# EasyEDA Pro project kuafu01_030内部老化方案_4.eprj, board PCB4 (continued)
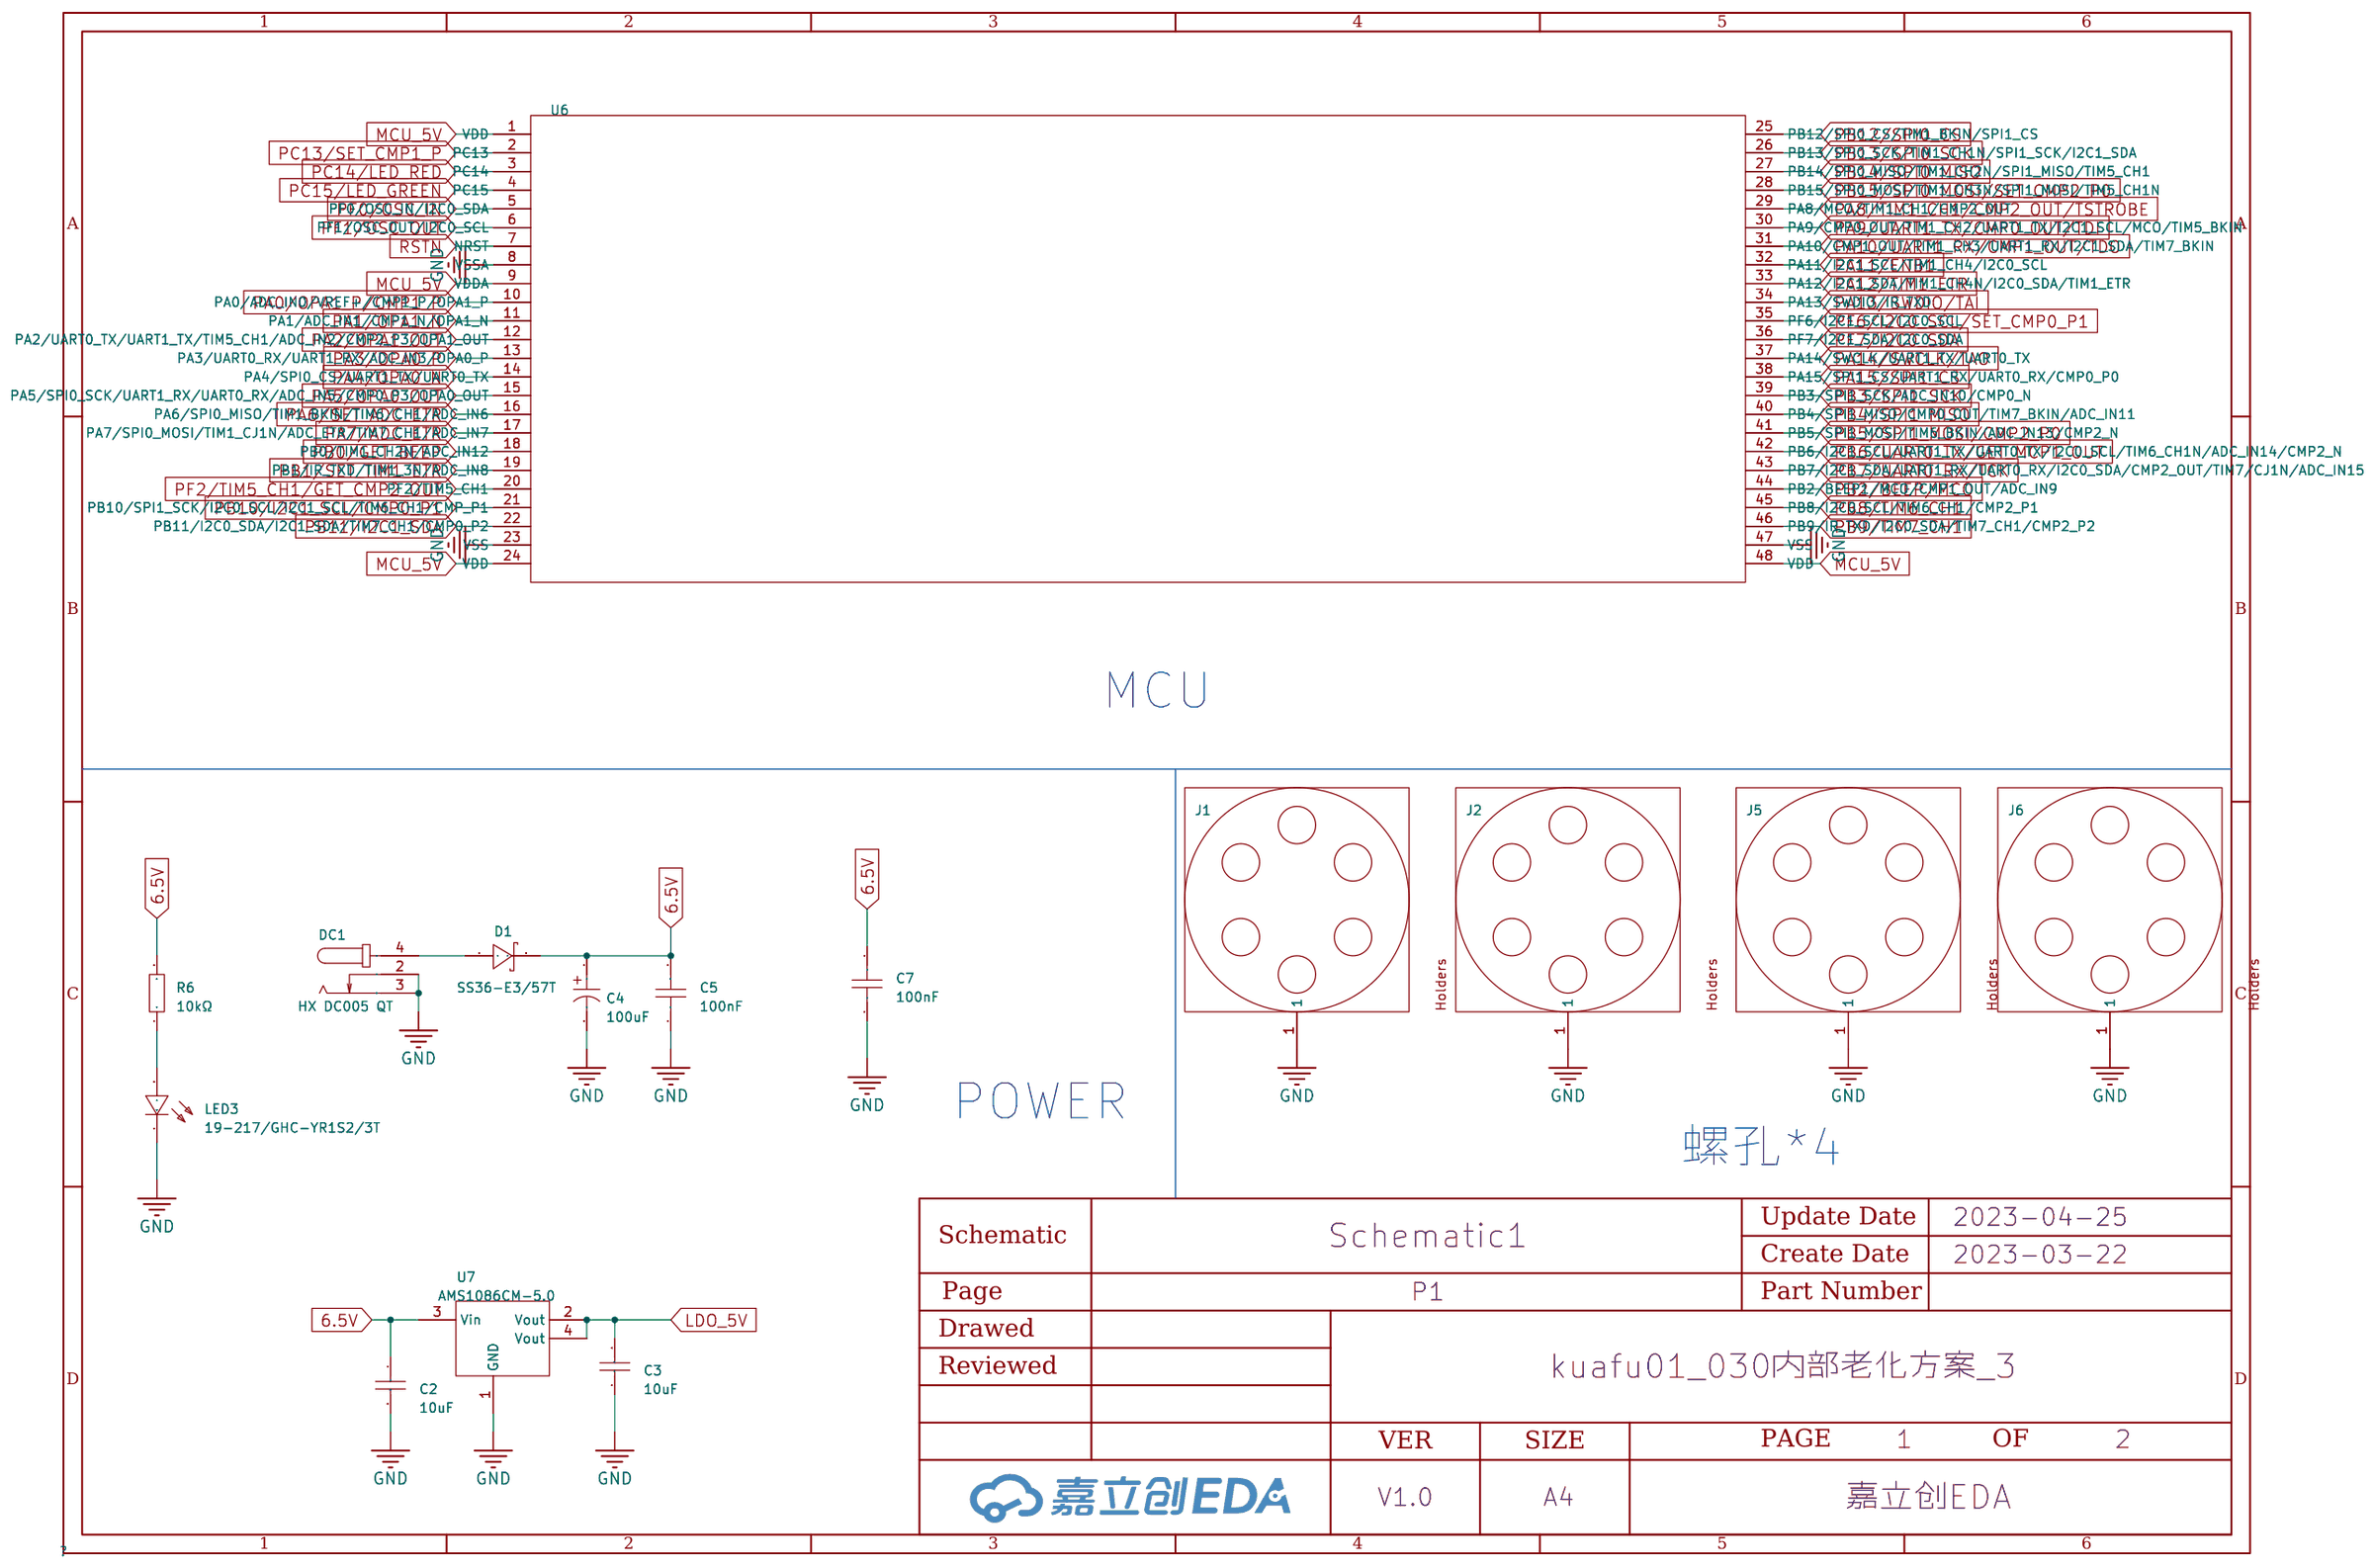
[diagram p0: P1]
## Nets (continued)
PC13/SET_CMP1_P: H7.2 H7#2.2 H7#3.2 H7#4.2 H7#5.2 H7#6.2 H7#7.2 H7#8.2 H7#9.2 H7#10.2 H7#11.2 H7#12.2 H7#13.2 H7#14.2 H7#15.2 H7#16.2 H7#17.2 H7#18.2 H7#19.2 H7#20.2 H7#21.2 H7#22.2 H7#23.2 H7#24.2 H7#25.2 H7#26.2 H7#27.2 H7#28.2 H7#29.2 H7#30.2 H7#31.2 H7#32.2 U6.2 U6#2.2 U6#3.2 U6#4.2 U6#5.2 U6#6.2 U6#7.2 U6#8.2 U6#9.2 U6#10.2 U6#11.2 U6#12.2 U6#13.2 U6#14.2 U6#15.2 U6#16.2 U6#17.2 U6#18.2 U6#19.2 U6#20.2 U6#21.2 U6#22.2 U6#23.2 U6#24.2 U6#25.2 U6#26.2 U6#27.2 U6#28.2 U6#29.2 U6#30.2 U6#31.2 U6#32.2
PC14/LED_RED: H1.2 H1#2.2 H1#3.2 H1#4.2 H1#5.2 H1#6.2 H1#7.2 H1#8.2 H1#9.2 H1#10.2 H1#11.2 H1#12.2 H1#13.2 H1#14.2 H1#15.2 H1#16.2 H1#17.2 H1#18.2 H1#19.2 H1#20.2 H1#21.2 H1#22.2 H1#23.2 H1#24.2 H1#25.2 H1#26.2 H1#27.2 H1#28.2 H1#29.2 H1#30.2 H1#31.2 H1#32.2 U6.3 U6#2.3 U6#3.3 U6#4.3 U6#5.3 U6#6.3 U6#7.3 U6#8.3 U6#9.3 U6#10.3 U6#11.3 U6#12.3 U6#13.3 U6#14.3 U6#15.3 U6#16.3 U6#17.3 U6#18.3 U6#19.3 U6#20.3 U6#21.3 U6#22.3 U6#23.3 U6#24.3 U6#25.3 U6#26.3 U6#27.3 U6#28.3 U6#29.3 U6#30.3 U6#31.3 U6#32.3
PC15/LED_GREEN: H2.2 H2#2.2 H2#3.2 H2#4.2 H2#5.2 H2#6.2 H2#7.2 H2#8.2 H2#9.2 H2#10.2 H2#11.2 H2#12.2 H2#13.2 H2#14.2 H2#15.2 H2#16.2 H2#17.2 H2#18.2 H2#19.2 H2#20.2 H2#21.2 H2#22.2 H2#23.2 H2#24.2 H2#25.2 H2#26.2 H2#27.2 H2#28.2 H2#29.2 H2#30.2 H2#31.2 H2#32.2 U6.4 U6#2.4 U6#3.4 U6#4.4 U6#5.4 U6#6.4 U6#7.4 U6#8.4 U6#9.4 U6#10.4 U6#11.4 U6#12.4 U6#13.4 U6#14.4 U6#15.4 U6#16.4 U6#17.4 U6#18.4 U6#19.4 U6#20.4 U6#21.4 U6#22.4 U6#23.4 U6#24.4 U6#25.4 U6#26.4 U6#27.4 U6#28.4 U6#29.4 U6#30.4 U6#31.4 U6#32.4
PERIPHERAL_5V: C1.1 C1#2.1 C1#3.1 C1#4.1 C1#5.1 C1#6.1 C1#7.1 C1#8.1 C1#9.1 C1#10.1 C1#11.1 C1#12.1 C1#13.1 C1#14.1 C1#15.1 C1#16.1 C1#17.1 C1#18.1 C1#19.1 C1#20.1 C1#21.1 C1#22.1 C1#23.1 C1#24.1 C1#25.1 C1#26.1 C1#27.1 C1#28.1 C1#29.1 C1#30.1 C1#31.1 C1#32.1 H9.1 H9#2.1 H9#3.1 H9#4.1 H9#5.1 H9#6.1 H9#7.1 H9#8.1 H9#9.1 H9#10.1 H9#11.1 H9#12.1 H9#13.1 H9#14.1 H9#15.1 H9#16.1 H9#17.1 H9#18.1 H9#19.1 H9#20.1 H9#21.1 H9#22.1 H9#23.1 H9#24.1 H9#25.1 H9#26.1 H9#27.1 H9#28.1 H9#29.1 H9#30.1 H9#31.1 H9#32.1 LED1.2 LED1#2.2 LED1#3.2 LED1#4.2 LED1#5.2 LED1#6.2 LED1#7.2 LED1#8.2 LED1#9.2 LED1#10.2 LED1#11.2 LED1#12.2 LED1#13.2 LED1#14.2 LED1#15.2 LED1#16.2 LED1#17.2 LED1#18.2 LED1#19.2 LED1#20.2 LED1#21.2 LED1#22.2 LED1#23.2 LED1#24.2 LED1#25.2 LED1#26.2 LED1#27.2 LED1#28.2 LED1#29.2 LED1#30.2 LED1#31.2 LED1#32.2 LED2.2 LED2#2.2 LED2#3.2 LED2#4.2 LED2#5.2 LED2#6.2 LED2#7.2 LED2#8.2 LED2#9.2 LED2#10.2 LED2#11.2 LED2#12.2 LED2#13.2 LED2#14.2 LED2#15.2 LED2#16.2 LED2#17.2 LED2#18.2 LED2#19.2 LED2#20.2 LED2#21.2 LED2#22.2 LED2#23.2 LED2#24.2 LED2#25.2 LED2#26.2 LED2#27.2 LED2#28.2 LED2#29.2 LED2#30.2 LED2#31.2 LED2#32.2 R3.2 R3#2.2 R3#3.2 R3#4.2 R3#5.2 R3#6.2 R3#7.2 R3#8.2 R3#9.2 R3#10.2 R3#11.2 R3#12.2 R3#13.2 R3#14.2 R3#15.2 R3#16.2 R3#17.2 R3#18.2 R3#19.2 R3#20.2 R3#21.2 R3#22.2 R3#23.2 R3#24.2 R3#25.2 R3#26.2 R3#27.2 R3#28.2 R3#29.2 R3#30.2 R3#31.2 R3#32.2 R4.1 R4#2.1 R4#3.1 R4#4.1 R4#5.1 R4#6.1 R4#7.1 R4#8.1 R4#9.1 R4#10.1 R4#11.1 R4#12.1 R4#13.1 R4#14.1 R4#15.1 R4#16.1 R4#17.1 R4#18.1 R4#19.1 R4#20.1 R4#21.1 R4#22.1 R4#23.1 R4#24.1 R4#25.1 R4#26.1 R4#27.1 R4#28.1 R4#29.1 R4#30.1 R4#31.1 R4#32.1 R5.2 R5#2.2 R5#3.2 R5#4.2 R5#5.2 R5#6.2 R5#7.2 R5#8.2 R5#9.2 R5#10.2 R5#11.2 R5#12.2 R5#13.2 R5#14.2 R5#15.2 R5#16.2 R5#17.2 R5#18.2 R5#19.2 R5#20.2 R5#21.2 R5#22.2 R5#23.2 R5#24.2 R5#25.2 R5#26.2 R5#27.2 R5#28.2 R5#29.2 R5#30.2 R5#31.2 R5#32.2 U1.1 U1#2.1 U1#3.1 U1#4.1 U1#5.1 U1#6.1 U1#7.1 U1#8.1 U1#9.1 U1#10.1 U1#11.1 U1#12.1 U1#13.1 U1#14.1 U1#15.1 U1#16.1 U1#17.1 U1#18.1 U1#19.1 U1#20.1 U1#21.1 U1#22.1 U1#23.1 U1#24.1 U1#25.1 U1#26.1 U1#27.1 U1#28.1 U1#29.1 U1#30.1 U1#31.1 U1#32.1 U2.5 U2#2.5 U2#3.5 U2#4.5 U2#5.5 U2#6.5 U2#7.5 U2#8.5 U2#9.5 U2#10.5 U2#11.5 U2#12.5 U2#13.5 U2#14.5 U2#15.5 U2#16.5 U2#17.5 U2#18.5 U2#19.5 U2#20.5 U2#21.5 U2#22.5 U2#23.5 U2#24.5 U2#25.5 U2#26.5 U2#27.5 U2#28.5 U2#29.5 U2#30.5 U2#31.5 U2#32.5
PF0/OSC_IN: U6.5 U6#2.5 U6#3.5 U6#4.5 U6#5.5 U6#6.5 U6#7.5 U6#8.5 U6#9.5 U6#10.5 U6#11.5 U6#12.5 U6#13.5 U6#14.5 U6#15.5 U6#16.5 U6#17.5 U6#18.5 U6#19.5 U6#20.5 U6#21.5 U6#22.5 U6#23.5 U6#24.5 U6#25.5 U6#26.5 U6#27.5 U6#28.5 U6#29.5 U6#30.5 U6#31.5 U6#32.5 X1.1 X1#2.1 X1#3.1 X1#4.1 X1#5.1 X1#6.1 X1#7.1 X1#8.1 X1#9.1 X1#10.1 X1#11.1 X1#12.1 X1#13.1 X1#14.1 X1#15.1 X1#16.1 X1#17.1 X1#18.1 X1#19.1 X1#20.1 X1#21.1 X1#22.1 X1#23.1 X1#24.1 X1#25.1 X1#26.1 X1#27.1 X1#28.1 X1#29.1 X1#30.1 X1#31.1 X1#32.1
PF1/OSC_OUT: U6.6 U6#2.6 U6#3.6 U6#4.6 U6#5.6 U6#6.6 U6#7.6 U6#8.6 U6#9.6 U6#10.6 U6#11.6 U6#12.6 U6#13.6 U6#14.6 U6#15.6 U6#16.6 U6#17.6 U6#18.6 U6#19.6 U6#20.6 U6#21.6 U6#22.6 U6#23.6 U6#24.6 U6#25.6 U6#26.6 U6#27.6 U6#28.6 U6#29.6 U6#30.6 U6#31.6 U6#32.6 X1.3 X1#2.3 X1#3.3 X1#4.3 X1#5.3 X1#6.3 X1#7.3 X1#8.3 X1#9.3 X1#10.3 X1#11.3 X1#12.3 X1#13.3 X1#14.3 X1#15.3 X1#16.3 X1#17.3 X1#18.3 X1#19.3 X1#20.3 X1#21.3 X1#22.3 X1#23.3 X1#24.3 X1#25.3 X1#26.3 X1#27.3 X1#28.3 X1#29.3 X1#30.3 X1#31.3 X1#32.3
PF2/TIM5_CH1/GET_CMP2_OUT: H5.2 H5#2.2 H5#3.2 H5#4.2 H5#5.2 H5#6.2 H5#7.2 H5#8.2 H5#9.2 H5#10.2 H5#11.2 H5#12.2 H5#13.2 H5#14.2 H5#15.2 H5#16.2 H5#17.2 H5#18.2 H5#19.2 H5#20.2 H5#21.2 H5#22.2 H5#23.2 H5#24.2 H5#25.2 H5#26.2 H5#27.2 H5#28.2 H5#29.2 H5#30.2 H5#31.2 H5#32.2 U6.20 U6#2.20 U6#3.20 U6#4.20 U6#5.20 U6#6.20 U6#7.20 U6#8.20 U6#9.20 U6#10.20 U6#11.20 U6#12.20 U6#13.20 U6#14.20 U6#15.20 U6#16.20 U6#17.20 U6#18.20 U6#19.20 U6#20.20 U6#21.20 U6#22.20 U6#23.20 U6#24.20 U6#25.20 U6#26.20 U6#27.20 U6#28.20 U6#29.20 U6#30.20 U6#31.20 U6#32.20
RSTN: CN1.2 CN1#2.2 CN1#3.2 CN1#4.2 CN1#5.2 CN1#6.2 CN1#7.2 CN1#8.2 CN1#9.2 CN1#10.2 CN1#11.2 CN1#12.2 CN1#13.2 CN1#14.2 CN1#15.2 CN1#16.2 CN1#17.2 CN1#18.2 CN1#19.2 CN1#20.2 CN1#21.2 CN1#22.2 CN1#23.2 CN1#24.2 CN1#25.2 CN1#26.2 CN1#27.2 CN1#28.2 CN1#29.2 CN1#30.2 CN1#31.2 CN1#32.2 U6.7 U6#2.7 U6#3.7 U6#4.7 U6#5.7 U6#6.7 U6#7.7 U6#8.7 U6#9.7 U6#10.7 U6#11.7 U6#12.7 U6#13.7 U6#14.7 U6#15.7 U6#16.7 U6#17.7 U6#18.7 U6#19.7 U6#20.7 U6#21.7 U6#22.7 U6#23.7 U6#24.7 U6#25.7 U6#26.7 U6#27.7 U6#28.7 U6#29.7 U6#30.7 U6#31.7 U6#32.7
$3N9153: D1.1 DC1.4
$3N9301: LED3.2 R6.1
$4N6329: LED2.1 LED2#2.1 LED2#3.1 LED2#4.1 LED2#5.1 LED2#6.1 LED2#7.1 LED2#8.1 LED2#9.1 LED2#10.1 LED2#11.1 LED2#12.1 LED2#13.1 LED2#14.1 LED2#15.1 LED2#16.1 LED2#17.1 LED2#18.1 LED2#19.1 LED2#20.1 LED2#21.1 LED2#22.1 LED2#23.1 LED2#24.1 LED2#25.1 LED2#26.1 LED2#27.1 LED2#28.1 LED2#29.1 LED2#30.1 LED2#31.1 LED2#32.1 R2.2 R2#2.2 R2#3.2 R2#4.2 R2#5.2 R2#6.2 R2#7.2 R2#8.2 R2#9.2 R2#10.2 R2#11.2 R2#12.2 R2#13.2 R2#14.2 R2#15.2 R2#16.2 R2#17.2 R2#18.2 R2#19.2 R2#20.2 R2#21.2 R2#22.2 R2#23.2 R2#24.2 R2#25.2 R2#26.2 R2#27.2 R2#28.2 R2#29.2 R2#30.2 R2#31.2 R2#32.2
$4N6330: LED1.1 LED1#2.1 LED1#3.1 LED1#4.1 LED1#5.1 LED1#6.1 LED1#7.1 LED1#8.1 LED1#9.1 LED1#10.1 LED1#11.1 LED1#12.1 LED1#13.1 LED1#14.1 LED1#15.1 LED1#16.1 LED1#17.1 LED1#18.1 LED1#19.1 LED1#20.1 LED1#21.1 LED1#22.1 LED1#23.1 LED1#24.1 LED1#25.1 LED1#26.1 LED1#27.1 LED1#28.1 LED1#29.1 LED1#30.1 LED1#31.1 LED1#32.1 R1.2 R1#2.2 R1#3.2 R1#4.2 R1#5.2 R1#6.2 R1#7.2 R1#8.2 R1#9.2 R1#10.2 R1#11.2 R1#12.2 R1#13.2 R1#14.2 R1#15.2 R1#16.2 R1#17.2 R1#18.2 R1#19.2 R1#20.2 R1#21.2 R1#22.2 R1#23.2 R1#24.2 R1#25.2 R1#26.2 R1#27.2 R1#28.2 R1#29.2 R1#30.2 R1#31.2 R1#32.2
$4N10186: H7.1 H7#2.1 H7#3.1 H7#4.1 H7#5.1 H7#6.1 H7#7.1 H7#8.1 H7#9.1 H7#10.1 H7#11.1 H7#12.1 H7#13.1 H7#14.1 H7#15.1 H7#16.1 H7#17.1 H7#18.1 H7#19.1 H7#20.1 H7#21.1 H7#22.1 H7#23.1 H7#24.1 H7#25.1 H7#26.1 H7#27.1 H7#28.1 H7#29.1 H7#30.1 H7#31.1 H7#32.1 U2.3 U2#2.3 U2#3.3 U2#4.3 U2#5.3 U2#6.3 U2#7.3 U2#8.3 U2#9.3 U2#10.3 U2#11.3 U2#12.3 U2#13.3 U2#14.3 U2#15.3 U2#16.3 U2#17.3 U2#18.3 U2#19.3 U2#20.3 U2#21.3 U2#22.3 U2#23.3 U2#24.3 U2#25.3 U2#26.3 U2#27.3 U2#28.3 U2#29.3 U2#30.3 U2#31.3 U2#32.3
$4N10193: H6.1 H6#2.1 H6#3.1 H6#4.1 H6#5.1 H6#6.1 H6#7.1 H6#8.1 H6#9.1 H6#10.1 H6#11.1 H6#12.1 H6#13.1 H6#14.1 H6#15.1 H6#16.1 H6#17.1 H6#18.1 H6#19.1 H6#20.1 H6#21.1 H6#22.1 H6#23.1 H6#24.1 H6#25.1 H6#26.1 H6#27.1 H6#28.1 H6#29.1 H6#30.1 H6#31.1 H6#32.1 U2.6 U2#2.6 U2#3.6 U2#4.6 U2#5.6 U2#6.6 U2#7.6 U2#8.6 U2#9.6 U2#10.6 U2#11.6 U2#12.6 U2#13.6 U2#14.6 U2#15.6 U2#16.6 U2#17.6 U2#18.6 U2#19.6 U2#20.6 U2#21.6 U2#22.6 U2#23.6 U2#24.6 U2#25.6 U2#26.6 U2#27.6 U2#28.6 U2#29.6 U2#30.6 U2#31.6 U2#32.6
$4N10258: H2.1 H2#2.1 H2#3.1 H2#4.1 H2#5.1 H2#6.1 H2#7.1 H2#8.1 H2#9.1 H2#10.1 H2#11.1 H2#12.1 H2#13.1 H2#14.1 H2#15.1 H2#16.1 H2#17.1 H2#18.1 H2#19.1 H2#20.1 H2#21.1 H2#22.1 H2#23.1 H2#24.1 H2#25.1 H2#26.1 H2#27.1 H2#28.1 H2#29.1 H2#30.1 H2#31.1 H2#32.1 R2.1 R2#2.1 R2#3.1 R2#4.1 R2#5.1 R2#6.1 R2#7.1 R2#8.1 R2#9.1 R2#10.1 R2#11.1 R2#12.1 R2#13.1 R2#14.1 R2#15.1 R2#16.1 R2#17.1 R2#18.1 R2#19.1 R2#20.1 R2#21.1 R2#22.1 R2#23.1 R2#24.1 R2#25.1 R2#26.1 R2#27.1 R2#28.1 R2#29.1 R2#30.1 R2#31.1 R2#32.1
$4N10262: H1.1 H1#2.1 H1#3.1 H1#4.1 H1#5.1 H1#6.1 H1#7.1 H1#8.1 H1#9.1 H1#10.1 H1#11.1 H1#12.1 H1#13.1 H1#14.1 H1#15.1 H1#16.1 H1#17.1 H1#18.1 H1#19.1 H1#20.1 H1#21.1 H1#22.1 H1#23.1 H1#24.1 H1#25.1 H1#26.1 H1#27.1 H1#28.1 H1#29.1 H1#30.1 H1#31.1 H1#32.1 R1.1 R1#2.1 R1#3.1 R1#4.1 R1#5.1 R1#6.1 R1#7.1 R1#8.1 R1#9.1 R1#10.1 R1#11.1 R1#12.1 R1#13.1 R1#14.1 R1#15.1 R1#16.1 R1#17.1 R1#18.1 R1#19.1 R1#20.1 R1#21.1 R1#22.1 R1#23.1 R1#24.1 R1#25.1 R1#26.1 R1#27.1 R1#28.1 R1#29.1 R1#30.1 R1#31.1 R1#32.1
$4N16114: H8.1 H8#2.1 H8#3.1 H8#4.1 H8#5.1 H8#6.1 H8#7.1 H8#8.1 H8#9.1 H8#10.1 H8#11.1 H8#12.1 H8#13.1 H8#14.1 H8#15.1 H8#16.1 H8#17.1 H8#18.1 H8#19.1 H8#20.1 H8#21.1 H8#22.1 H8#23.1 H8#24.1 H8#25.1 H8#26.1 H8#27.1 H8#28.1 H8#29.1 H8#30.1 H8#31.1 H8#32.1 U2.4 U2#2.4 U2#3.4 U2#4.4 U2#5.4 U2#6.4 U2#7.4 U2#8.4 U2#9.4 U2#10.4 U2#11.4 U2#12.4 U2#13.4 U2#14.4 U2#15.4 U2#16.4 U2#17.4 U2#18.4 U2#19.4 U2#20.4 U2#21.4 U2#22.4 U2#23.4 U2#24.4 U2#25.4 U2#26.4 U2#27.4 U2#28.4 U2#29.4 U2#30.4 U2#31.4 U2#32.4
$4N17047: H11.2 H11#2.2 H11#3.2 H11#4.2 H11#5.2 H11#6.2 H11#7.2 H11#8.2 H11#9.2 H11#10.2 H11#11.2 H11#12.2 H11#13.2 H11#14.2 H11#15.2 H11#16.2 H11#17.2 H11#18.2 H11#19.2 H11#20.2 H11#21.2 H11#22.2 H11#23.2 H11#24.2 H11#25.2 H11#26.2 H11#27.2 H11#28.2 H11#29.2 H11#30.2 H11#31.2 H11#32.2 R4.2 R4#2.2 R4#3.2 R4#4.2 R4#5.2 R4#6.2 R4#7.2 R4#8.2 R4#9.2 R4#10.2 R4#11.2 R4#12.2 R4#13.2 R4#14.2 R4#15.2 R4#16.2 R4#17.2 R4#18.2 R4#19.2 R4#20.2 R4#21.2 R4#22.2 R4#23.2 R4#24.2 R4#25.2 R4#26.2 R4#27.2 R4#28.2 R4#29.2 R4#30.2 R4#31.2 R4#32.2
$4N17074: H12.2 H12#2.2 H12#3.2 H12#4.2 H12#5.2 H12#6.2 H12#7.2 H12#8.2 H12#9.2 H12#10.2 H12#11.2 H12#12.2 H12#13.2 H12#14.2 H12#15.2 H12#16.2 H12#17.2 H12#18.2 H12#19.2 H12#20.2 H12#21.2 H12#22.2 H12#23.2 H12#24.2 H12#25.2 H12#26.2 H12#27.2 H12#28.2 H12#29.2 H12#30.2 H12#31.2 H12#32.2 R5.1 R5#2.1 R5#3.1 R5#4.1 R5#5.1 R5#6.1 R5#7.1 R5#8.1 R5#9.1 R5#10.1 R5#11.1 R5#12.1 R5#13.1 R5#14.1 R5#15.1 R5#16.1 R5#17.1 R5#18.1 R5#19.1 R5#20.1 R5#21.1 R5#22.1 R5#23.1 R5#24.1 R5#25.1 R5#26.1 R5#27.1 R5#28.1 R5#29.1 R5#30.1 R5#31.1 R5#32.1
$4N17158: H13.2 H13#2.2 H13#3.2 H13#4.2 H13#5.2 H13#6.2 H13#7.2 H13#8.2 H13#9.2 H13#10.2 H13#11.2 H13#12.2 H13#13.2 H13#14.2 H13#15.2 H13#16.2 H13#17.2 H13#18.2 H13#19.2 H13#20.2 H13#21.2 H13#22.2 H13#23.2 H13#24.2 H13#25.2 H13#26.2 H13#27.2 H13#28.2 H13#29.2 H13#30.2 H13#31.2 H13#32.2 R3.1 R3#2.1 R3#3.1 R3#4.1 R3#5.1 R3#6.1 R3#7.1 R3#8.1 R3#9.1 R3#10.1 R3#11.1 R3#12.1 R3#13.1 R3#14.1 R3#15.1 R3#16.1 R3#17.1 R3#18.1 R3#19.1 R3#20.1 R3#21.1 R3#22.1 R3#23.1 R3#24.1 R3#25.1 R3#26.1 R3#27.1 R3#28.1 R3#29.1 R3#30.1 R3#31.1 R3#32.1

Pads without a net: U6 49; U6#2 49; U6#3 49; U6#4 49; U6#5 49; U6#6 49; U6#7 49; U6#8 49; U6#9 49; U6#10 49; U6#11 49; U6#12 49; U6#13 49; U6#14 49; U6#15 49; U6#16 49; U6#17 49; U6#18 49; U6#19 49; U6#20 49; U6#21 49; U6#22 49; U6#23 49; U6#24 49; U6#25 49; U6#26 49; U6#27 49; U6#28 49; U6#29 49; U6#30 49; U6#31 49; U6#32 49

## Via types
v1: diameter 0.5, hole 0.3, Top Layer to Bottom Layer, 2116 vias
v2: diameter 0.7, hole 0.5, Top Layer to Bottom Layer, 580 vias
v3: diameter 0.61, hole 0.305, Top Layer to Bottom Layer, 32 vias

## Routing (per net, layer and track width the routed paths; a pad name or vN(x,y) marks a point on that pad's centre or on a via; arc(x,y) is an arc through that point)
2.048V: length 571.2
  Top Layer w0.28: C6#24.2 9.32,8.71 U1#24.2 11.26,8.55 16.2,3.61 18.32,3.61 19.42,4.71 U2#24.1 ; C6#21.2 160.96,83.9 U1#23.2 162.9,83.74 167.84,78.8 169.96,78.8 171.06,79.9 U2#20.1 ; U2#23.1 19.42,230.26 18.32,229.16 16.2,229.16 11.26,234.1 U1#22.2 9.32,234.27 C6#23.2 ; C6#14.2 110.41,234.27 U1#12.2 112.35,234.1 117.29,229.16 119.42,229.16 120.52,230.26 U2#21.1 ; C6#8.2 59.87,159.08 U1#10.2 61.81,158.92 66.75,153.98 68.87,153.98 69.97,155.08 U2#4.1 ; C6#27.2 211.51,234.27 U1#27.2 213.44,234.1 218.38,229.16 220.51,229.16 221.61,230.26 U2#27.1 ; U2#32.1 171.06,192.67 169.96,191.57 167.84,191.57 162.9,196.51 U1#30.2 160.96,196.67 C6#32.2 ; C6.2 110.41,121.49 U1#5.2 112.35,121.33 117.29,116.39 119.42,116.39 120.52,117.49 U2.1 ; U2#31.1 120.52,192.67 119.42,191.57 117.29,191.57 112.35,196.51 U1#28.2 110.41,196.67 C6#28.2 ; C6#18.2 59.87,46.31 U1#20.2 61.81,46.14 66.75,41.2 68.87,41.2 69.97,42.3 U2#14.1 ; U2#2.1 19.42,117.49 18.32,116.39 16.2,116.39 11.26,121.33 U1#4.2 9.32,121.49 C6#3.2 ; C6#6.2 211.51,121.49 U1#7.2 213.44,121.33 218.38,116.39 220.51,116.39 221.61,117.49 U2#7.1 ; U2#10.1 171.06,155.08 169.96,153.98 167.84,153.98 162.9,158.92 U1#11.2 160.96,159.08 C6#10.2 ; U2#29.1 69.97,192.67 68.87,191.57 66.75,191.57 61.81,196.51 U1#32.2 59.87,196.67 C6#31.2 ; U2#22.1 120.52,79.9 119.42,78.8 117.29,78.8 112.35,83.74 U1#14.2 110.41,83.9 C6#22.2 ; C6#15.2 211.51,83.9 U1#19.2 213.44,83.74 218.38,78.8 220.51,78.8 221.61,79.9 U2#16.1 ; U2#5.1 221.61,155.08 220.51,153.98 218.38,153.98 213.44,158.92 U1#8.2 211.51,159.08 C6#4.2 ; U2#13.1 19.42,42.3 18.32,41.2 16.2,41.2 11.26,46.14 U1#15.2 9.32,46.31 C6#13.2 ; C6#25.2 211.51,8.71 U1#25.2 213.44,8.55 218.38,3.61 220.51,3.61 221.61,4.71 U2#25.1 ; U2#26.1 171.06,230.26 169.96,229.16 167.84,229.16 162.9,234.1 U1#26.2 160.96,234.27 C6#26.2 ; C6#7.2 59.87,121.49 U1#9.2 61.81,121.33 66.75,116.39 68.87,116.39 69.97,117.49 U2#3.1 ; U2#28.1 221.61,192.67 220.51,191.57 218.38,191.57 213.44,196.51 U1#31.2 211.51,196.67 C6#29.2 ; U2#9.1 171.06,117.49 169.96,116.39 167.84,116.39 162.9,121.33 U1#2.2 160.96,121.49 C6#9.2 ; U2#11.1 120.52,155.08 119.42,153.98 117.29,153.98 112.35,158.92 U1#3.2 110.41,159.08 C6#11.2 ; C6#5.2 9.32,159.08 U1#6.2 11.26,158.92 16.2,153.98 18.32,153.98 19.42,155.08 U2#6.1 ; C6#20.2 160.96,46.31 U1#13.2 162.9,46.14 167.84,41.2 169.96,41.2 171.06,42.3 U2#19.1 ; C6#30.2 9.32,196.67 U1#29.2 11.26,196.51 16.2,191.57 18.32,191.57 19.42,192.67 U2#30.1 ; C6#16.2 9.32,83.9 U1#17.2 11.26,83.74 16.2,78.8 18.32,78.8 19.42,79.9 U2#17.1 ; C6#12.2 110.41,46.31 U1#16.2 112.35,46.14 117.29,41.2 119.42,41.2 120.52,42.3 U2#12.1 ; C6#19.2 59.87,83.9 U1#21.2 61.81,83.74 66.75,78.8 68.87,78.8 69.97,79.9 U2#15.1 ; U2#18.1 221.61,42.3 220.51,41.2 218.38,41.2 213.44,46.14 U1#18.2 211.51,46.31 C6#17.2 ; C6#2.2 59.87,234.27 U1.2 61.81,234.1 66.75,229.16 68.87,229.16 69.97,230.26 U2#8.1
6.5V: length 61.2
  Top Layer w0.5: v2(107.95,7.11) 103.51,11.56 U7.3 103.49,15.04 C7.2 99.4,15.02 C5.2 97.04,15.03 R6.2 94.63,15.03 C2.1 91.54,15.04 D1.2 87.9,8.71 C4.1 ; v2(128.02,7.37) 131.57,10.92 U7#2.3
  Bottom Layer w0.5: v2(128.02,7.37) 127.76,7.11 v2(107.95,7.11)
GND: length 7193.9
  Top Layer w0.28: v2(224,8.32) 224,8.34 227.21,11.56 228.82,11.56 ; v2(135.53,157.7) 135.19,157.36 134.44,157.36 134.17,157.62 U6#8.23 ; X1#22.2 70.17,89.4 v2(70.98,90.21) ; X1#7.4 v2(223.71,123.44) ; X1#21.4 v2(72.07,48.25) ; v2(224,83.51) 224,83.53 227.21,86.74 228.82,86.74 ; v2(84.98,232.88) 84.64,232.54 83.89,232.54 83.63,232.81 U6.23 ; v2(227.8,30.03) 225.52,27.75 225.52,20.89 226.82,19.59 229.32,19.59 230.77,18.14 U6#24.47 ; v2(25.61,67.62) 23.33,65.34 23.33,58.48 24.63,57.18 27.13,57.18 28.58,55.74 U6#14.47 ; v2(135.53,120.11) 135.19,119.77 134.44,119.77 134.17,120.03 U6#2.23 ; v2(126.71,105.22) 124.43,102.94 124.43,96.08 125.73,94.78 128.23,94.78 129.68,93.33 U6#19.47 ; X1#26.4 v2(173.16,236.21) ; U6#4.47 230.77,130.92 229.32,132.37 226.82,132.37 225.52,133.67 225.52,140.53 v2(227.8,142.81) ; v2(236.62,82.52) 236.28,82.18 235.53,82.18 235.27,82.44 U6#17.23 ; v2(122.91,121.1) 122.91,121.12 126.12,124.33 127.73,124.33 ; v2(21.81,8.32) 21.81,8.34 25.03,11.56 26.63,11.56 ; v2(222.62,52.61) 221.81,51.8 X1#18.2 ; v2(122.91,196.28) 122.91,196.3 126.12,199.52 127.73,199.52 ; v2(227.8,105.22) 225.52,102.94 225.52,96.08 226.82,94.78 229.32,94.78 230.77,93.33 U6#17.47 ; v2(121.53,202.98) 120.72,202.17 X1#31.2 ; U6#30.47 129.68,206.1 128.23,207.55 125.73,207.55 124.43,208.85 124.43,215.71 v2(126.71,217.99) ; v2(122.91,233.87) 122.91,233.89 126.12,237.11 127.73,237.11 ; v2(70.98,165.39) 70.17,164.58 X1#11.2 ; X1#16.4 v2(122.62,236.21) ; v2(173.45,158.69) 173.45,158.71 176.67,161.92 U6#10.8 ; X1#4.4 v2(173.16,123.44) ; v2(34.43,44.92) 34.09,44.58 33.34,44.58 33.08,44.85 U6#14.23 ; v2(76.16,255.58) 73.88,253.3 73.88,246.44 75.18,245.14 77.68,245.14 79.13,243.69 79.13,242.06 ; 79.13,54.1 79.13,55.74 77.68,57.18 75.18,57.18 73.88,58.48 73.88,65.34 v2(76.16,67.62) ; X1#13.4 v2(21.52,48.25) ; X1#3.4 v2(21.52,123.44) ; v2(177.25,255.58) 174.97,253.3 174.97,246.44 176.27,245.14 178.77,245.14 180.22,243.69 180.22,242.06 ; X1#24.4 v2(21.52,10.66) ; v2(236.62,7.33) 236.28,6.99 235.53,6.99 235.27,7.25 U6#24.23 ; 228.82,237.11 227.21,237.11 224,233.89 v2(224,233.87) ; X1#14.4 v2(173.16,48.25) ; v2(122.91,83.51) 122.91,83.53 126.12,86.74 127.73,86.74 ; v2(224,196.28) 224,196.3 227.21,199.52 228.82,199.52 ; v2(224,45.91) 224,45.93 227.21,49.15 228.82,49.15 ; v2(122.91,45.91) 122.91,45.93 126.12,49.15 127.73,49.15 ; v2(172.07,165.39) 171.26,164.58 X1#9.2 ; v2(186.07,120.11) 185.73,119.77 184.98,119.77 184.72,120.03 U6#7.23 ; 180.22,166.87 180.22,168.51 178.77,169.96 176.27,169.96 174.97,171.26 174.97,178.12 v2(177.25,180.4) ; 26.63,199.52 25.03,199.52 21.81,196.3 v2(21.81,196.28) ; 26.63,49.15 25.03,49.15 21.81,45.93 v2(21.81,45.91) ; X1#10.4 v2(72.07,123.44) ; v2(126.71,255.58) 124.43,253.3 124.43,246.44 125.73,245.14 128.23,245.14 129.68,243.69 U6#12.47 ; U6#13.23 134.17,44.85 134.44,44.58 135.19,44.58 v2(135.53,44.92) ; U6#22.8 75.57,86.74 72.36,83.53 v2(72.36,83.51) ; v2(236.62,157.7) 236.28,157.36 235.53,157.36 235.27,157.62 U6#6.23 ; v2(121.53,52.61) 120.72,51.8 X1#12.2 ; 228.82,161.92 227.21,161.92 224,158.71 v2(224,158.69) ; v2(236.62,195.29) 236.28,194.95 235.53,194.95 235.27,195.21 U6#28.23 ; v2(20.43,90.21) 19.62,89.4 X1#17.2 ; U6#5.8 75.57,124.33 72.36,121.12 v2(72.36,121.1) ; v2(20.43,127.8) 19.62,126.99 X1#3.2 ; v2(173.45,196.28) 173.45,196.3 176.67,199.52 U6#32.8 ; X1#2.2 120.72,126.99 v2(121.53,127.8) ; U6#31.47 28.58,206.1 27.13,207.55 24.63,207.55 23.33,208.85 23.33,215.71 v2(25.61,217.99) ; X1#8.4 v2(122.62,161.03) ; v2(186.07,157.7) 185.73,157.36 184.98,157.36 184.72,157.62 U6#10.23 ; v2(222.62,90.21) 221.81,89.4 X1#15.2 ; v2(72.36,45.91) 72.36,45.93 75.57,49.15 U6#16.8 ; v2(177.25,67.62) 174.97,65.34 174.97,58.48 176.27,57.18 178.77,57.18 180.22,55.74 180.22,54.1 ; U6#30.23 134.17,195.21 134.44,194.95 135.19,194.95 v2(135.53,195.29) ; U6#9.23 33.08,157.62 33.34,157.36 34.09,157.36 v2(34.43,157.7) ; X1#6.2 19.62,164.58 v2(20.43,165.39) ; X1#31.4 v2(122.62,198.62) ; v2(70.98,240.57) 70.17,239.76 X1.2 ; 79.13,204.47 79.13,206.1 77.68,207.55 75.18,207.55 73.88,208.85 73.88,215.71 v2(76.16,217.99) ; v2(227.8,180.4) 225.52,178.12 225.52,171.26 226.82,169.96 229.32,169.96 230.77,168.51 U6#6.47 ; v2(227.8,255.58) 225.52,253.3 225.52,246.44 226.82,245.14 229.32,245.14 230.77,243.69 U6#26.47 ; U6#29.23 83.63,195.21 83.89,194.95 84.64,194.95 v2(84.98,195.29) ; v2(172.07,52.61) 171.26,51.8 X1#14.2 ; 180.22,204.47 180.22,206.1 178.77,207.55 176.27,207.55 174.97,208.85 174.97,215.71 v2(177.25,217.99) ; X1#28.4 v2(223.71,198.62) ; 127.73,161.92 126.12,161.92 122.91,158.71 v2(122.91,158.69) ; 180.22,91.69 180.22,93.33 178.77,94.78 176.27,94.78 174.97,96.08 174.97,102.94 v2(177.25,105.22) ; X1#12.4 v2(122.62,48.25) ; X1#32.4 v2(173.16,198.62) ; U6#8.47 129.68,168.51 128.23,169.96 125.73,169.96 124.43,171.26 124.43,178.12 v2(126.71,180.4) ; X1#5.4 v2(223.71,161.03) ; X1#9.4 v2(173.16,161.03) ; X1#15.4 v2(223.71,85.85) ; U6#5.23 83.63,120.03 83.89,119.77 84.64,119.77 v2(84.98,120.11) ; v2(173.45,121.1) 173.45,121.12 176.67,124.33 U6#7.8 ; U6#15.23 235.27,44.85 235.53,44.58 236.28,44.58 v2(236.62,44.92) ; v2(224,121.1) 224,121.12 227.21,124.33 228.82,124.33 ; v2(172.07,90.21) 171.26,89.4 X1#20.2 ; v2(173.45,83.51) 173.45,83.53 176.67,86.74 U6#21.8 ; v2(34.43,82.52) 34.09,82.18 33.34,82.18 33.08,82.44 U6#20.23 ; U6#25.23 184.72,232.81 184.98,232.54 185.73,232.54 v2(186.07,232.88) ; v2(34.43,120.11) 34.09,119.77 33.34,119.77 33.08,120.03 U6#3.23 ; X1#8.2 120.72,164.58 v2(121.53,165.39) ; v2(172.07,127.8) 171.26,126.99 X1#4.2 ; v2(20.43,240.57) 19.62,239.76 X1#23.2 ; X1#24.2 19.62,14.21 v2(20.43,15.02) ; v2(222.62,127.8) 221.81,126.99 X1#7.2 ; U6#16.23 83.63,44.85 83.89,44.58 84.64,44.58 v2(84.98,44.92) ; X1#18.4 v2(223.71,48.25) ; v2(172.07,202.98) 171.26,202.17 X1#32.2 ; v2(236.62,232.88) 236.28,232.54 235.53,232.54 235.27,232.81 U6#26.23 ; U6#19.23 134.17,82.44 134.44,82.18 135.19,82.18 v2(135.53,82.52) ; v2(222.62,165.39) 221.81,164.58 X1#5.2 ; v2(21.81,233.87) 21.81,233.89 25.03,237.11 26.63,237.11 ; v2(76.16,142.81) 73.88,140.53 73.88,133.67 75.18,132.37 77.68,132.37 79.13,130.92 79.13,129.28 ; X1#10.2 70.17,126.99 v2(70.98,127.8) ; v2(126.71,67.62) 124.43,65.34 124.43,58.48 125.73,57.18 128.23,57.18 129.68,55.74 U6#13.47 ; v2(20.43,202.98) 19.62,202.17 X1#29.2 ; v2(70.98,52.61) 70.17,51.8 X1#21.2 ; X1#25.2 221.81,14.21 v2(222.62,15.02) ; v2(25.61,142.81) 23.33,140.53 23.33,133.67 24.63,132.37 27.13,132.37 28.58,130.92 U6#3.47 ; v2(135.53,232.88) 135.19,232.54 134.44,232.54 134.17,232.81 U6#12.23 ; v2(21.81,83.51) 21.81,83.53 25.03,86.74 26.63,86.74 ; v2(227.8,67.62) 225.52,65.34 225.52,58.48 226.82,57.18 229.32,57.18 230.77,55.74 U6#15.47 ; v2(34.43,232.88) 34.09,232.54 33.34,232.54 33.08,232.81 U6#27.23 ; v2(172.07,240.57) 171.26,239.76 X1#26.2 ; v2(186.07,44.92) 185.73,44.58 184.98,44.58 184.72,44.85 U6#18.23 ; v2(186.07,195.29) 185.73,194.95 184.98,194.95 184.72,195.21 U6#32.23 ; 79.13,91.69 79.13,93.33 77.68,94.78 75.18,94.78 73.88,96.08 73.88,102.94 v2(76.16,105.22) ; v2(72.36,196.28) 72.36,196.3 75.57,199.52 U6#29.8 ; X1#2.4 v2(122.62,123.44) ; U6#18.8 176.67,49.15 173.45,45.93 v2(173.45,45.91) ; U6#23.47 28.58,18.14 27.13,19.59 24.63,19.59 23.33,20.89 23.33,27.75 v2(25.61,30.03) ; v2(121.53,240.57) 120.72,239.76 X1#16.2 ; v2(84.98,82.52) 84.64,82.18 83.89,82.18 83.63,82.44 U6#22.23 ; 79.13,166.87 79.13,168.51 77.68,169.96 75.18,169.96 73.88,171.26 73.88,178.12 v2(76.16,180.4) ; X1#23.4 v2(21.52,236.21) ; X1#20.4 v2(173.16,85.85) ; U6#27.47 28.58,243.69 27.13,245.14 24.63,245.14 23.33,246.44 23.33,253.3 v2(25.61,255.58) ; U6#31.23 33.08,195.21 33.34,194.95 34.09,194.95 v2(34.43,195.29) ; X1#30.2 70.17,202.17 v2(70.98,202.98) ; X1#28.2 221.81,202.17 v2(222.62,202.98) ; v2(25.61,180.4) 23.33,178.12 23.33,171.26 24.63,169.96 27.13,169.96 28.58,168.51 U6#9.47 ; X1#27.4 v2(223.71,236.21) ; U6.8 75.57,237.11 72.36,233.89 v2(72.36,233.87) ; X1#6.4 v2(21.52,161.03) ; v2(222.62,240.57) 221.81,239.76 X1#27.2 ; v2(186.07,82.52) 185.73,82.18 184.98,82.18 184.72,82.44 U6#21.23 ; X1#29.4 v2(21.52,198.62) ; v2(34.43,7.33) 34.09,6.99 33.34,6.99 33.08,7.25 U6#23.23 ; v2(21.81,121.1) 21.81,121.12 25.03,124.33 26.63,124.33 ; U6#28.47 230.77,206.1 229.32,207.55 226.82,207.55 225.52,208.85 225.52,215.71 v2(227.8,217.99) ; 26.63,161.92 25.03,161.92 21.81,158.71 v2(21.81,158.69) ; U6#2.47 129.68,130.92 128.23,132.37 125.73,132.37 124.43,133.67 124.43,140.53 v2(126.71,142.81) ; v2(121.53,90.21) 120.72,89.4 X1#19.2 ; U6#25.8 176.67,237.11 173.45,233.89 v2(173.45,233.87) ; U6#11.8 75.57,161.92 72.36,158.71 v2(72.36,158.69) ; X1#19.4 v2(122.62,85.85) ; v2(84.98,157.7) 84.64,157.36 83.89,157.36 83.63,157.62 U6#11.23 ; 180.22,129.28 180.22,130.92 178.77,132.37 176.27,132.37 174.97,133.67 174.97,140.53 v2(177.25,142.81) ; X1#22.4 v2(72.07,85.85) ; X1#13.2 19.62,51.8 v2(20.43,52.61) ; U6#20.47 28.58,93.33 27.13,94.78 24.63,94.78 23.33,96.08 23.33,102.94 v2(25.61,105.22) ; U6#4.23 235.27,120.03 235.53,119.77 236.28,119.77 v2(236.62,120.11) ; X1#30.4 v2(72.07,198.62) ; X1#11.4 v2(72.07,161.03) ; X1#17.4 v2(21.52,85.85) ; X1.4 v2(72.07,236.21) ; X1#25.4 v2(223.71,10.66)